# EasyEDA Pro project FPGA-G1.eprj, board logi Pi (continued)
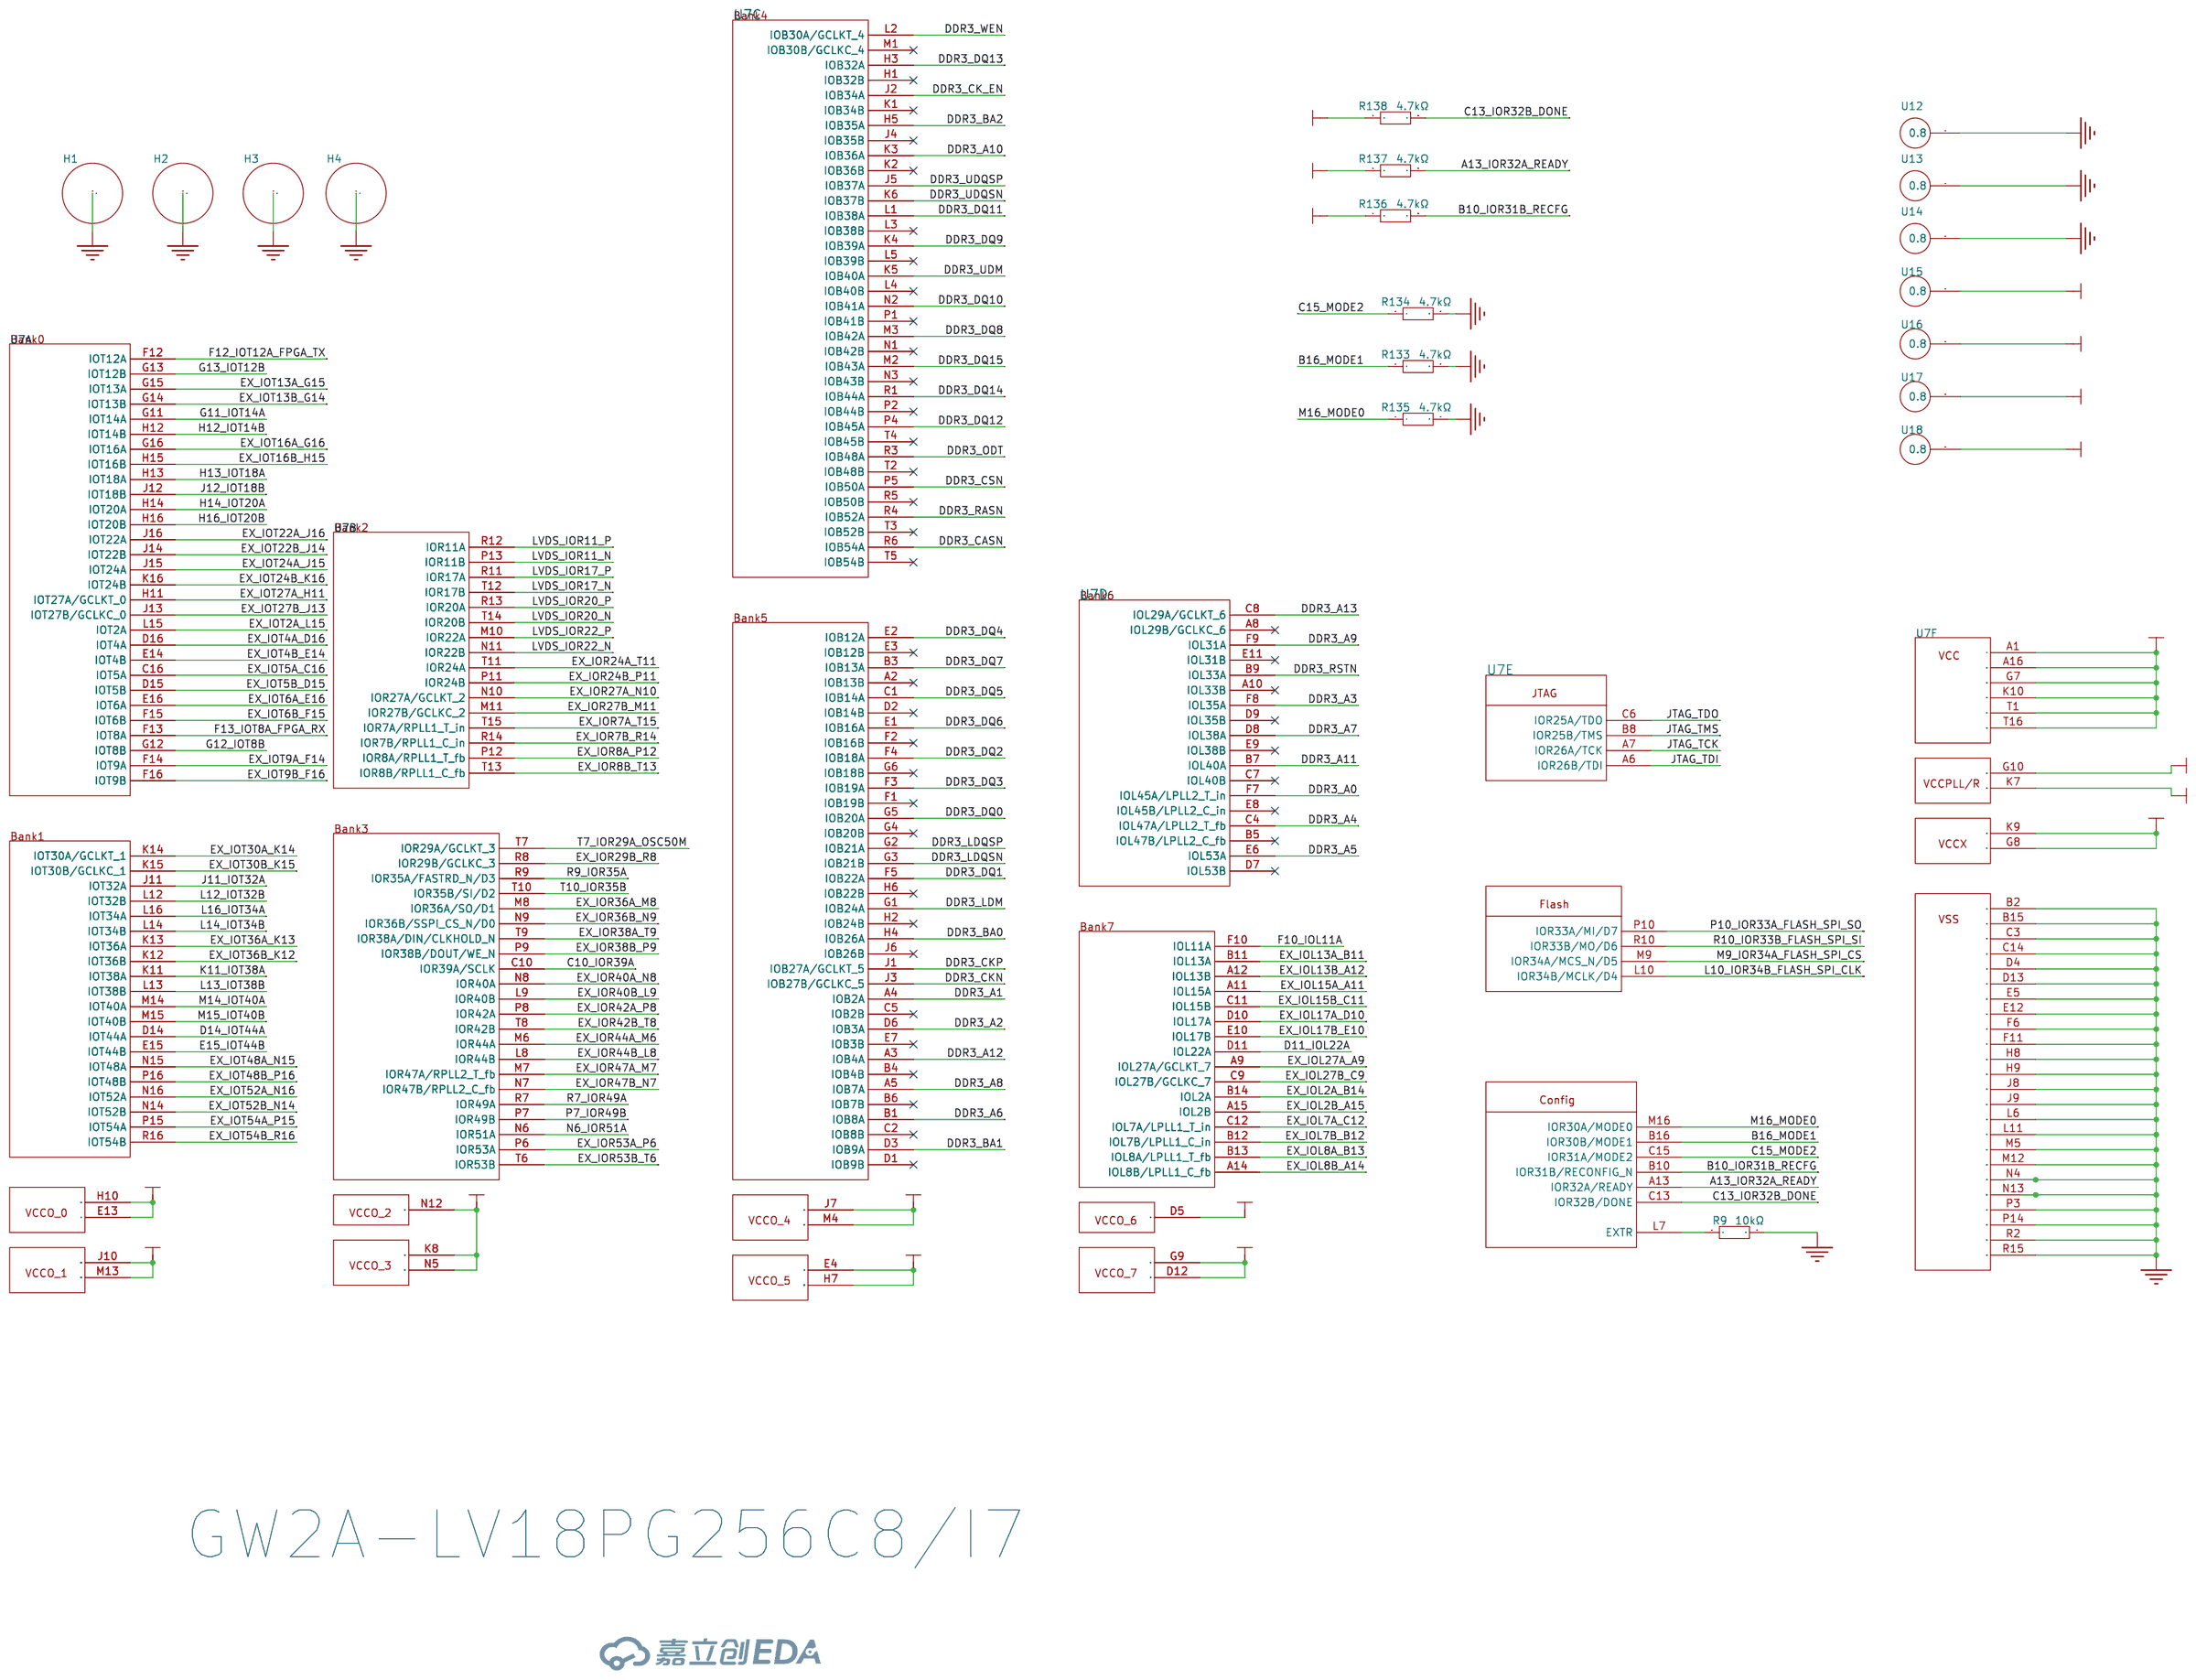
[diagram p0: FPGA]
## Routing (per net, layer and track width the routed paths; a pad name or vN(x,y) marks a point on that pad's centre or on a via; arc(x,y) is an arc through that point) (continued)
C6_IOR25A_JTAG_TDO: length 3.4
  Top Layer w0.109: RN1.2 15.28,62.31 14.96,62.62 14.96,62.97 14.51,63.42 U20.6
C10_IOR39A: length 32.2
  Top Layer w0.109: 17.38,25.22 v1(17.38,25.64) ; U7.C10 v1(29.7,42.09)
  SIG04 w0.109: v1(17.38,25.64) 18.03,25.64 19.42,24.26 20.98,24.26 21.71,23.53 23.44,23.53 23.75,23.84 26.9,23.84 29.11,26.05 29.11,29.37 28.95,29.53 28.47,29.53 28.14,29.86 28.14,38.99 29.33,40.18 29.33,41.71 v1(29.7,42.09)
C13_IOR32B_DONE: length 5.5
  Top Layer w0.109: v1(33.6,45.36) 33.92,45.36 34.24,45.68 R138.2 ; U7.C13 v1(32.7,42.09)
  SIG03 w0.109: v1(32.7,42.09) 33.6,42.99 v1(33.6,45.36)
C15_MODE2: length 6
  Top Layer w0.109: R134.1 35.16,45.64 36.09,44.72 36.09,43.69 35.49,43.09 34.95,43.09 34.71,42.85 34.71,42.09 34.22,41.59 U7.C15
D11_IOL22A: length 34.1
  Top Layer w0.109: 27.28,18.63 28.06,18.63 28.62,18.07 ; 26.72,16.41 26.49,16.19 26.49,13.6 26.77,13.32 R61.1 28.64,13.32 SW2.1 ; 26.72,16.41 26.74,16.43 27.14,16.43 ; 26.72,16.41 26.71,16.41 26.5,16.62 26.5,18.44 26.77,18.71 27,18.71 ; 27.18,18.65 27.18,19.2 26.97,19.4 v1(26.52,19.4) ; U7.D11 v1(29.7,40.09)
  SIG04 w0.109: v1(26.52,19.4) 27.75,20.64 27.75,23.62 29.32,25.18 29.32,30.49 29.1,30.71 29.1,39.23 29.7,39.83 v1(29.7,40.09)
D14_IOT44A: length 15.2
  Top Layer w0.109: v1(34.33,52.25) 33.81,52.25 33.52,52.54 33.52,53.36 33.62,53.46 U1.13 ; U7.D14 v1(33.7,41.09)
  SIG04 w0.109: v1(34.33,52.25) 33.7,51.62 33.7,48.6 33.19,48.09 33.19,43.6 33.32,43.47 33.32,41.48 v1(33.7,41.09)
DDR3_A0: length 27.2
  Top Layer w0.109: U7.F7 v1(25.7,39.09) ; U29.N3 v1(15.1,38.64)
  SIG04 w0.109: v1(25.7,39.09) 25.7,39.08 25.28,38.65 25.28,36.76 25.42,36.61 26.65,36.61 26.81,36.46 26.81,35.68 26.61,35.49 25.88,35.49 25.87,35.49 25.48,35.49 25.4,35.57 25.4,35.94 25.32,36.02 25.15,36.02 25.07,35.94 25.07,35.57 25,35.49 24.54,35.49 24.43,35.6 24.43,38.2 24,38.64 22.61,38.64 22.45,38.8 18.65,38.8 18.08,38.23 15.51,38.23 v1(15.1,38.64)
  Bottom Layer w0.109: v1(15.1,38.64) 15.1,40.27 14.73,40.64 14.14,40.64 13.88,40.9 R123.2
DDR3_A1: length 26.7
  Top Layer w0.109: v1(11.1,39.44) U29.P7 12.5,40.04 12.5,42.02 12,42.51 R122.2 ; v1(22.7,44) 23.11,43.59 U7.A4
  SIG03 w0.109: v1(11.1,39.44) 11.1,40.12 16.51,45.52 18.03,45.52 18.11,45.45 18.11,44.97 18.19,44.89 18.36,44.89 18.44,44.97 18.44,45.45 18.52,45.52 18.69,45.52 18.77,45.45 18.77,44.97 18.84,44.89 19.02,44.89 19.09,44.97 19.09,45.45 19.17,45.52 19.34,45.52 19.42,45.45 19.42,44.97 19.5,44.89 19.67,44.89 19.75,44.97 19.75,45.45 19.83,45.52 20,45.52 20.08,45.45 20.08,44.97 20.15,44.89 20.33,44.89 20.4,44.97 20.4,45.45 20.48,45.52 20.65,45.52 20.73,45.45 20.73,44.97 20.81,44.89 20.98,44.89 21.06,44.97 21.06,45.45 21.14,45.52 22,45.52 22.23,45.3 22.23,44.47 v1(22.7,44)
DDR3_A2: length 25.2
  Top Layer w0.109: R121.2 13.52,42.55 v1(13.52,40.26) 13.52,39.9 14.36,39.06 14.72,39.06 ; U7.D6 v1(24.7,41.09)
  SIG04 w0.109: 13.53,40.24 13.53,41.01 13.98,41.46 15.01,41.46 15.09,41.38 15.09,40.71 15.17,40.63 15.34,40.63 15.42,40.71 15.42,41.38 15.49,41.46 15.67,41.46 15.74,41.38 15.74,40.71 15.82,40.63 15.99,40.63 16.07,40.71 16.07,41.38 16.15,41.46 17.62,41.46 18.11,41.96 18.11,42.07 18.03,42.15 18.03,42.26 18.15,42.38 18.26,42.38 18.34,42.3 18.45,42.3 19.63,43.48 21.16,43.48 21.24,43.4 21.24,42.91 21.32,42.84 21.49,42.84 21.57,42.91 21.57,43.4 21.65,43.48 21.82,43.48 21.9,43.4 21.9,42.91 21.97,42.84 22.15,42.84 22.22,42.91 22.22,43.4 22.3,43.48 22.9,43.48 24.7,41.68 v1(24.7,41.09)
DDR3_A3: length 27.1
  Top Layer w0.109: U7.F8 v1(26.7,39.09) ; 15.6,42.8 15.6,42.2 v1(15.87,41.92) ; U29.N2 v1(15.9,38.64)
  SIG04 w0.109: v1(15.9,38.64) 15.9,38.67 16.36,39.13 17.5,39.13 17.58,39.05 17.58,38.91 17.65,38.83 17.83,38.83 17.9,38.91 17.9,39.05 17.98,39.13 19.36,39.13 19.43,39.21 19.43,39.63 19.51,39.71 19.68,39.71 19.76,39.63 19.76,39.21 19.84,39.13 20.01,39.13 20.09,39.21 20.09,39.61 20.17,39.69 20.34,39.69 20.42,39.61 20.42,39.2 20.49,39.13 20.67,39.13 20.74,39.21 20.74,39.57 20.82,39.64 21,39.64 21.07,39.57 21.07,39.21 21.15,39.13 21.32,39.13 21.4,39.21 21.4,39.58 21.48,39.66 21.65,39.66 21.73,39.58 21.73,39.21 21.81,39.13 22.02,39.13 22.51,39.62 24.61,39.62 24.68,39.69 24.68,39.86 24.76,39.93 24.93,39.93 25.01,39.86 25.01,39.69 25.09,39.62 25.26,39.62 25.34,39.69 25.34,39.86 25.42,39.93 25.59,39.93 25.67,39.86 25.67,39.69 25.74,39.62 27.09,39.62 27.41,39.3 27.41,38.7 27.22,38.5 27.22,37.83 27.03,37.64 26.39,37.64 26.24,37.79 26.24,38.63 v1(26.7,39.09)
  Bottom Layer w0.109: v1(15.87,41.92) 15.43,41.49 15.43,39.11 v1(15.9,38.64)
DDR3_A4: length 24.6
  Top Layer w0.109: U7.C4 22.7,42.09 v1(22.7,43.09) ; U29.P8 v1(10.3,39.44)
  SIG03 w0.109: v1(22.7,43.09) 21.25,43.09 20.86,43.48 20.35,43.48 20.14,43.26 20.14,43.06 20.06,42.99 19.88,42.99 19.81,43.06 19.81,43.26 19.73,43.34 19.56,43.34 19.48,43.26 19.48,43.06 19.4,42.99 19.23,42.99 19.15,43.06 19.15,43.26 19.08,43.34 18.9,43.34 18.83,43.26 18.83,43.06 18.75,42.99 18.57,42.99 18.5,43.06 18.5,43.26 18.42,43.34 18.25,43.34 18.17,43.26 18.17,43.06 18.09,42.99 17.92,42.99 17.84,43.06 17.84,43.26 17.76,43.34 17.59,43.34 17.51,43.26 17.51,43.06 17.44,42.99 17.26,42.99 17.19,43.06 17.19,43.26 17.11,43.34 16.94,43.34 16.86,43.26 16.86,43.06 16.78,42.99 16.61,42.99 16.53,43.06 16.53,43.26 16.45,43.34 16.28,43.34 16.2,43.26 16.2,43.06 16.13,42.99 15.95,42.99 15.88,43.06 15.88,43.26 15.8,43.34 15.35,43.34 13.92,41.9 13.92,41.2 12.87,40.16 12.87,39.8 11.29,38.21 10.89,38.21 10.69,38.41 10.69,39.05 v1(10.3,39.44)
  Bottom Layer w0.109: v1(10.3,39.44) 9.92,39.83 9.2,39.83 8.67,40.36 R119.1
DDR3_A5: length 25.1
  Top Layer w0.109: U29.P2 15.64,39.04 15.89,39.3 15.89,40.24 ; U7.E6 25.7,40.09 v1(25.7,42.09)
  SIG04 w0.109: v1(25.7,42.09) 25.82,41.97 25.82,40.8 25.66,40.64 25.52,40.64 25.44,40.72 25.44,41.36 25.37,41.44 25.19,41.44 25.12,41.36 25.12,40.72 25.04,40.64 24.55,40.64 24.14,41.05 24.14,41.62 23.28,42.48 23.17,42.48 23.09,42.4 23.09,42.06 23.02,41.99 22.84,41.99 22.77,42.06 22.77,42.4 22.69,42.48 22.52,42.48 22.44,42.4 22.44,42.06 22.36,41.99 22.19,41.99 22.11,42.06 22.11,42.4 22.03,42.48 21.23,42.48 21.15,42.4 21.15,42.06 21.08,41.99 20.9,41.99 20.83,42.06 20.83,42.4 20.75,42.48 20.58,42.48 20.5,42.4 20.5,42.06 20.42,41.99 20.25,41.99 20.17,42.06 20.17,42.4 20.09,42.48 19.48,42.48 17.24,40.24 v1(15.89,40.24)
  Bottom Layer w0.109: v1(15.89,40.24) 16.29,40.64 16.29,42.45 16.7,42.85 R118.1
DDR3_A6: length 25.7
  Top Layer w0.109: U7.B1 19.02,43.77 19.02,45.7 v1(18.62,46.1) ; U29.R8 v1(10.3,40.24)
  SIG03 w0.109: v1(18.62,46.1) 18.61,46.11 15.94,46.11 15.6,45.77 15.6,45.66 15.81,45.45 15.81,45.34 15.69,45.22 15.58,45.22 15.37,45.43 15.26,45.43 15.14,45.31 15.14,45.2 15.35,44.98 15.35,44.88 15.23,44.75 15.12,44.75 14.91,44.97 14.8,44.97 14.67,44.84 14.67,44.74 14.89,44.52 14.89,44.41 14.77,44.29 14.66,44.29 14.44,44.5 14.33,44.5 14.21,44.38 14.21,44.27 14.42,44.06 14.42,43.95 14.3,43.83 14.19,43.83 13.98,44.04 13.87,44.04 13.75,43.92 13.75,43.81 13.96,43.59 13.96,43.49 13.84,43.36 13.73,43.36 13.51,43.58 13.41,43.58 13.28,43.45 13.28,43.35 13.5,43.13 13.5,43.02 13.38,42.9 13.27,42.9 13.05,43.11 12.94,43.11 12.82,42.99 12.82,42.88 13.03,42.67 13.03,42.56 12.91,42.44 12.8,42.44 12.59,42.65 12.48,42.65 12.36,42.53 12.36,42.42 12.57,42.2 12.57,42.09 12.45,41.97 12.34,41.97 12.12,42.19 12.02,42.19 11.89,42.06 11.89,41.96 12.11,41.74 12.11,41.63 11.98,41.51 11.88,41.51 11.66,41.72 11.55,41.72 10.3,40.47 v1(10.3,40.24)
  Bottom Layer w0.109: v1(10.3,40.24) 9.88,40.67 9.88,41.23 8.26,42.85 R117.1
DDR3_A7: length 23.6
  Top Layer w0.109: U7.D8 27.2,40.65 v1(26.74,41.11) ; v1(15.1,41.89) 15.1,40.25 U29.R2
  SIG04 w0.109: v1(26.74,41.11) 27.27,41.64 27.27,42.07 25.69,43.65 25.58,43.65 25.4,43.48 25.29,43.48 25.17,43.6 25.17,43.71 25.34,43.88 25.34,43.99 25.22,44.12 25.11,44.12 24.94,43.94 24.83,43.94 24.71,44.06 24.71,44.17 24.88,44.35 24.88,44.46 24.58,44.75 18.6,44.75 18.49,44.64 18.49,44.22 18.41,44.15 18.24,44.15 18.16,44.22 18.16,44.64 18.08,44.71 17.91,44.71 17.83,44.64 17.83,44.22 17.75,44.15 17.58,44.15 17.5,44.22 17.5,44.64 17.39,44.75 17.01,44.75 15.1,42.84 v1(15.1,41.89)
  Bottom Layer w0.109: v1(15.1,41.89) 15.1,42.2 R116.1
DDR3_A8: length 24.5
  Top Layer w0.109: U29.T8 v1(10.3,41.04) 10.1,41.25 R115.1 ; U7.A5 24.29,43.59 ; 24.2,43.59 24.17,43.59 22.67,45.09
  SIG04 w0.109: v1(22.7,45.14) 22.45,45.14 21.89,45.69 15.68,45.69 15.33,45.34 15.33,45.23 15.7,44.86 15.7,44.75 15.58,44.63 15.47,44.63 15.09,45 14.98,45 14.86,44.88 14.86,44.77 15.24,44.4 15.24,44.29 15.11,44.17 15,44.17 14.63,44.54 14.52,44.54 14.4,44.42 14.4,44.31 14.77,43.93 14.77,43.83 14.65,43.7 14.54,43.7 14.17,44.08 14.06,44.08 13.94,43.95 13.94,43.84 14.31,43.47 14.31,43.36 14.19,43.24 14.08,43.24 13.7,43.61 13.59,43.61 13.34,43.36 13.23,43.36 13.11,43.49 13,43.49 12.87,43.37 12.87,43.26 13,43.13 13,43.02 11.02,41.04 v1(10.3,41.04)
DDR3_A9: length 25.4
  Top Layer w0.109: v1(26.74,40.11) 27.44,40.11 27.73,39.81 27.73,39.03 28.17,38.59 U7.F9 ; U29.R3 v1(14.3,40.24) 14.3,40.31 13.87,40.74 13.87,41.99 14.77,42.89 R114.1
  SIG04 w0.109: 26.71,40.05 26.71,40.13 26.53,40.32 24.41,40.32 24.16,40.57 23.51,40.57 23.17,40.91 23.17,41.37 22.91,41.63 22.42,41.63 22.34,41.55 22.34,41.33 22.26,41.25 22.09,41.25 22.01,41.33 22.01,41.55 21.94,41.63 21.15,41.63 21.07,41.55 21.07,40.91 21,40.84 20.82,40.84 20.74,40.91 20.74,41.55 20.67,41.63 20.49,41.63 20.42,41.55 20.42,40.91 20.34,40.84 20.17,40.84 20.09,40.91 20.09,41.55 20.01,41.63 19.84,41.63 19.76,41.55 19.76,40.91 19.68,40.84 19.51,40.84 19.43,40.91 19.43,41.55 19.36,41.63 19.09,41.63 17.25,39.79 14.75,39.79 v1(14.3,40.24)
DDR3_A10: length 29
  Top Layer w0.109: v1(11.1,37.04) U29.L7 12.83,37.97 12.83,42.83 R113.1 ; U7.K3 v1(21.7,34.09)
  SIG04 w0.109: v1(11.1,37.04) 11.1,37.51 11.31,37.72 12.91,37.72 15.57,35.06 16.74,35.06 18.17,36.49 18.57,36.49 18.65,36.41 18.65,36.08 18.73,36 18.9,36 18.98,36.08 18.98,36.41 19.05,36.49 19.23,36.49 19.3,36.41 19.3,35.95 19.38,35.88 19.55,35.88 19.63,35.95 19.63,36.41 19.71,36.49 19.88,36.49 19.96,36.41 19.96,36.03 20.04,35.95 20.21,35.95 20.29,36.03 20.29,36.41 20.36,36.49 20.88,36.49 21.55,35.82 21.55,35.59 21.47,35.51 20.78,35.51 20.7,35.43 20.7,35.26 20.78,35.18 21.62,35.18 21.7,35.1 21.7,34.93 21.62,34.85 20.78,34.85 20.7,34.78 20.7,34.6 20.78,34.53 21.62,34.53 21.7,34.45 v1(21.7,34.09)
DDR3_A11: length 25.6
  Top Layer w0.109: v1(12.04,40.29) 11.59,39.84 U29.R7 11.11,40.24 11.11,42.83 R112.1 ; U7.B7 v1(25.7,43.09)
  SIG03 w0.109: v1(12.04,40.29) 12.04,40.59 15.86,44.41 16.65,44.41 16.72,44.49 16.72,44.78 16.8,44.85 16.97,44.85 17.05,44.78 17.05,44.49 17.13,44.41 17.3,44.41 17.38,44.49 17.38,44.78 17.46,44.85 17.63,44.85 17.71,44.78 17.71,44.49 17.78,44.41 21.51,44.41 22.31,43.62 23.09,43.62 23.16,43.54 23.16,43.04 23.24,42.96 23.41,42.96 23.49,43.04 23.49,43.54 23.57,43.62 23.74,43.62 23.82,43.54 23.82,43.04 23.9,42.96 24.07,42.96 24.15,43.04 24.15,43.54 24.22,43.62 24.4,43.62 24.47,43.54 24.47,43.04 24.55,42.96 24.72,42.96 24.8,43.04 24.8,43.54 24.88,43.62 25.18,43.62 v1(25.7,43.09)
DDR3_A12: length 27.4
  Top Layer w0.109: 21.66,45.09 21.73,45.09 22.2,44.62 U7.A3 ; U29.N7 v1(11.1,38.64)
  SIG04 w0.109: 21.66,45.09 21.39,45.37 16.87,45.37 14.15,42.65 14.04,42.65 13.64,43.05 13.53,43.05 13.41,42.93 13.41,42.82 13.81,42.42 13.81,42.31 13.69,42.19 13.58,42.19 13.18,42.59 13.07,42.59 12.95,42.47 12.95,42.36 13.35,41.96 13.35,41.85 13.22,41.73 13.12,41.73 12.72,42.13 12.61,42.13 12.48,42 12.48,41.89 12.88,41.49 12.88,41.39 12.76,41.26 12.65,41.26 12.25,41.66 12.14,41.66 12.02,41.54 12.02,41.43 12.42,41.03 12.42,40.92 12.19,40.69 11.16,40.69 10.72,40.24 10.72,39.03 v1(11.1,38.64)
  Bottom Layer w0.109: R111.1 9.18,42.89 10.69,41.39 10.69,38.99 11.04,38.64 v1(11.1,38.64)
  vias: v1(21.7,45.14)
DDR3_A13: length 24.3
  Top Layer w0.109: U7.C8 v1(26.7,42.09) ; U29.T3 v1(14.3,41.04)
  SIG03 w0.109: v1(26.7,42.09) 26.19,42.6 25.3,42.6 25.22,42.52 25.22,41.86 25.14,41.78 24.97,41.78 24.89,41.86 24.89,42.52 24.81,42.6 24.64,42.6 24.56,42.52 24.56,41.86 24.49,41.78 24.31,41.78 24.24,41.86 24.24,42.52 24.16,42.6 23.99,42.6 23.91,42.52 23.91,41.86 23.83,41.78 23.66,41.78 23.58,41.86 23.58,42.52 23.5,42.6 23.33,42.6 23.25,42.52 23.25,41.86 23.18,41.78 23,41.78 22.93,41.86 22.93,42.52 22.85,42.6 22.68,42.6 22.6,42.52 22.6,41.86 22.52,41.78 22.35,41.78 22.27,41.86 22.27,42.52 22.19,42.6 15.08,42.6 14.3,41.83 v1(14.3,41.04)
  Bottom Layer w0.109: R110.1 14.3,42.35 v1(14.3,41.04)
DDR3_BA0: length 28
  Top Layer w0.109: U7.H4 v1(22.7,37.09) ; U29.M2 15.9,37.84
  Bottom Layer w0.109: v1(22.7,37.09) 22.7,38.34 22.5,38.54 22.12,38.54 22.04,38.62 22.04,39.53 21.96,39.61 21.79,39.61 21.71,39.53 21.71,38.62 21.64,38.54 21.46,38.54 21.39,38.62 21.39,39.53 21.31,39.61 21.14,39.61 21.06,39.53 21.06,38.62 20.98,38.54 20.81,38.54 20.73,38.62 20.73,39.53 20.65,39.61 20.48,39.61 20.4,39.53 20.4,38.62 20.33,38.54 20.15,38.54 20.08,38.62 20.08,39.53 20,39.61 19.83,39.61 19.75,39.53 19.75,38.62 19.67,38.54 18.96,38.54 18.26,37.84 17.69,37.84 17.61,37.92 17.61,38.63 17.69,38.71 18.3,38.71 18.38,38.79 18.38,38.96 18.3,39.04 17.69,39.04 17.61,39.12 17.61,39.55 17.53,39.63 17.36,39.63 17.28,39.55 17.28,37.92 17.21,37.84 15.9,37.84 ; v1(15.9,37.84) 16,37.84 16.45,38.29 16.45,39.27 17.11,39.94 17.11,41.55 17.63,42.07 R126.2
DDR3_BA1: length 24.1
  Top Layer w0.109: U7.D3 v1(21.7,41.09) ; U29.N8 v1(10.3,38.64)
  SIG04 w0.109: v1(10.3,38.64) 10.8,38.14 11.67,38.14 11.75,38.22 11.75,39.04 11.83,39.12 12,39.12 12.08,39.04 12.08,38.22 12.16,38.14 12.33,38.14 12.41,38.22 12.41,39.04 12.48,39.11 12.66,39.11 12.73,39.04 12.73,38.22 12.81,38.14 12.99,38.14 13.06,38.22 13.06,39.03 13.14,39.11 13.32,39.11 13.39,39.03 13.39,38.21 13.47,38.14 13.64,38.14 13.72,38.22 13.72,39.03 13.79,39.11 13.97,39.11 14.05,39.03 14.05,38.22 14.12,38.14 14.28,38.14 14.38,38.25 14.38,39.17 14.68,39.46 18.3,39.46 18.47,39.63 18.47,39.94 19,40.48 21.57,40.48 21.7,40.61 v1(21.7,41.09)
  Bottom Layer w0.109: R125.2 8.97,39.35 9.28,39.04 9.96,39.04 10.3,38.7 v1(10.3,38.64)
DDR3_BA2: length 28.2
  Top Layer w0.109: v1(15.1,37.85) 14.7,37.45 U29.M3 ; U7.H5 v1(23.7,37.09)
  Bottom Layer w0.109: v1(23.7,37.09) 22.85,36.24 22.85,35.83 22.7,35.68 22.34,35.68 22.2,35.82 22.2,36.19 22.13,36.26 21.56,36.26 21.48,36.34 21.48,36.51 21.56,36.59 22.13,36.59 22.2,36.67 22.2,37.33 22.08,37.46 20.05,37.46 19.97,37.38 19.97,36.38 19.89,36.3 19.72,36.3 19.64,36.38 19.64,37.38 19.57,37.46 19.39,37.46 19.32,37.38 19.32,36.38 19.24,36.3 19.07,36.3 18.99,36.38 18.99,37.38 18.91,37.46 18.74,37.46 18.66,37.38 18.66,36.38 18.58,36.3 18.41,36.3 18.33,36.38 18.33,37.38 18.26,37.46 18.08,37.46 18.01,37.38 18.01,36.38 17.93,36.3 17.75,36.3 17.68,36.38 17.68,37.38 17.6,37.46 15.49,37.46 v1(15.1,37.85) 13.91,39.03 13.91,40.41 13.42,40.9 13.42,42.38 12.94,42.85 R124.2
DDR3_CASN: length 29.7
  Top Layer w0.109: U29.K3 14.23,36.31 v1(14.23,37.04) ; U7.R6 24.7,29.09 v1(23.7,29.09)
  SIG04 w0.109: v1(23.7,29.09) 23.72,29.09 24.09,29.46 24.09,37.48 23.87,37.7 23.25,37.7 23.14,37.8 22.98,37.8 22.31,38.48 18.89,38.48 18.22,37.8 17.55,37.8 17.19,37.44 14.63,37.44 v1(14.23,37.04)
  Bottom Layer w0.109: v1(14.23,37.04) 12.76,38.52 12.76,41.18 R127.1
DDR3_CK_EN: length 23.7
  Top Layer w0.109: U29.K9 v1(9.5,36.24) ; U7.J2 21.09,35.59 v1(20.7,35.98)
  SIG04 w0.109: v1(20.7,35.98) 20.06,35.33 20.06,33.67 19.69,33.31 19.69,31.08 19.33,30.72 17.33,30.72 17.1,30.95 17.1,31.61 16.85,31.86 14.94,31.86 14.69,32.1 14.69,33.55 13.49,34.76 11.92,34.76 11.84,34.68 11.84,34.54 11.77,34.47 11.59,34.47 11.52,34.54 11.52,34.68 11.44,34.76 11.27,34.76 11.19,34.68 11.19,34.54 11.11,34.47 10.94,34.47 10.86,34.54 10.86,34.68 10.78,34.76 10.61,34.76 10.53,34.68 10.53,34.54 10.46,34.47 10.28,34.47 10.21,34.54 10.21,34.68 10.13,34.76 9.66,34.76 9.5,34.92 v1(9.5,36.24)
  Bottom Layer w0.109: 9.47,36.22 8.31,36.22 8.2,36.11
DDR3_CKN: length 23.4
  Top Layer w0.104: U7.J3 21.73,35.12 19.84,35.12 19.67,34.95 v1(19.67,34.32) ; U29.K7 v1(11.1,36.24)
  SIG04 w0.104: v1(11.1,36.24) 11.34,36 11.99,36 12.06,36.07 12.06,36.25 12.31,36.5 12.74,36.5 13,36.25 13,36.07 13.07,36 14,36 15.31,34.69 16.83,34.69 17.2,35.06 17.51,35.06 17.77,34.81 17.77,31.46 17.84,31.39 18.02,31.39 18.09,31.46 18.09,32.84 18.35,33.09 18.5,33.09 18.58,33.17 18.58,33.35 18.5,33.42 18.35,33.42 18.09,33.67 18.09,34.81 18.35,35.06 19.34,35.06 19.45,34.96 19.45,34.42 19.54,34.32 v1(19.67,34.32)
  Bottom Layer w0.104: R106.2 19.37,35.04 19.37,34.62 v1(19.67,34.32)
DDR3_CKP: length 23.4
  Top Layer w0.104: v1(18.76,34.32) 18.76,35.41 18.94,35.59 19.12,35.59 19.23,35.7 19.23,36.22 19.3,36.29 19.48,36.29 19.56,36.22 19.56,35.74 19.71,35.59 U7.J1 ; U29.J7 v1(11.1,35.44)
  SIG04 w0.104: v1(18.76,34.32) 18.77,34.32 19.02,34.32 19.14,34.44 19.14,34.63 19.02,34.75 18.47,34.75 18.4,34.68 18.4,33.8 18.47,33.73 18.63,33.73 18.88,33.47 18.88,33.04 18.63,32.79 18.47,32.79 18.4,32.71 18.4,31.33 18.15,31.08 17.71,31.08 17.46,31.33 17.46,34.67 17.39,34.74 17.31,34.74 16.9,34.32 15.1,34.32 13.73,35.69 12.88,35.69 12.69,35.88 12.69,36.12 12.62,36.2 12.44,36.2 12.36,36.12 12.36,35.82 12.24,35.69 11.33,35.69 11.1,35.47 v1(11.1,35.44)
  Bottom Layer w0.104: v1(18.76,34.32) 19.07,34.62 19.07,35.06 R106.1
DDR3_CSN: length 22.5
  Top Layer w0.109: U7.P5 v1(23.7,30.09) ; U29.L2 v1(15.9,37.04)
  SIG04 w0.109: v1(23.7,30.09) 23.7,29.8 23.59,29.69 23.3,29.69 23.19,29.8 23.19,31.24 23.27,31.32 23.39,31.32 23.47,31.4 23.47,31.57 23.39,31.65 23.27,31.65 23.19,31.73 23.19,32.83 23.41,33.05 23.41,33.29 23.49,33.37 23.65,33.37 23.73,33.44 23.73,33.62 23.65,33.69 23.49,33.69 23.41,33.77 23.41,33.94 23.49,34.02 23.65,34.02 23.73,34.1 23.73,34.27 23.65,34.35 23.49,34.35 23.41,34.43 23.41,34.77 23.19,35 23.19,35.01 23.11,35.08 22.91,35.08 22.83,35.16 22.83,35.33 22.91,35.41 23.11,35.41 23.19,35.49 23.19,35.66 23.11,35.74 22.92,35.74 22.85,35.82 22.85,35.99 22.92,36.07 23.11,36.07 23.19,36.14 23.19,36.32 23.11,36.39 22.88,36.39 22.8,36.47 22.8,36.64 22.88,36.72 23.11,36.72 23.19,36.8 23.19,37.15 22.86,37.48 22.2,37.48 22.12,37.55 22.12,37.65 22.04,37.73 21.87,37.73 21.79,37.65 21.79,37.55 21.72,37.48 21.54,37.48 21.46,37.55 21.46,37.75 21.39,37.82 21.21,37.82 21.14,37.75 21.14,37.55 21.06,37.48 20.89,37.48 20.81,37.55 20.81,37.58 20.73,37.66 20.56,37.66 20.48,37.58 20.48,37.55 20.4,37.48 20.23,37.48 20.15,37.55 20.15,37.65 20.08,37.73 19.9,37.73 19.83,37.65 19.83,37.55 19.75,37.48 19.58,37.48 19.5,37.55 19.5,37.65 19.42,37.73 19.25,37.73 19.17,37.65 19.17,37.55 19.09,37.48 18.92,37.48 18.84,37.55 18.84,37.64 18.77,37.71 18.59,37.71 18.52,37.64 18.52,37.55 18.44,37.48 17.68,37.48 16.86,36.65 16.29,36.65 v1(15.9,37.04) 15.91,37.05
DDR3_DQ0: length 21.2
  Top Layer w0.109: U7.G5 23.71,38.08 v1(23.7,38.08) ; U29.E3 v1(15.1,31.44)
  SIG03 w0.109: 17.77,31.31 17.77,30.66 17.85,30.59 18.02,30.59 18.1,30.66 ; v1(15.1,31.44) 15.49,31.05 17.04,31.05 17.12,30.97 17.12,30.66 17.19,30.59 17.37,30.59 17.44,30.66 ; 18.43,31.31 18.43,30.66 18.5,30.59 18.89,30.59 19.19,30.89 19.19,31.41 19.31,31.53 19.8,31.53 19.89,31.44 20,31.44 20.12,31.56 20.12,31.67 20.03,31.77 20.03,31.87 20.15,32 20.26,32 20.35,31.9 20.46,31.9 20.59,32.03 20.59,32.14 20.38,32.34 20.38,32.45 20.5,32.57 20.61,32.57 20.82,32.37 20.93,32.37 21.05,32.49 21.05,32.6 20.87,32.77 20.87,32.88 21,33.01 21.1,33.01 21.28,32.83 21.39,32.83 21.51,32.95 21.51,33.06 21.42,33.16 21.42,33.27 21.54,33.39 21.65,33.39 21.74,33.29 21.85,33.29 21.98,33.42 21.98,33.53 21.88,33.62 21.88,33.73 22.17,34.02 22.17,34.34 23.52,35.68 23.93,35.68 24.1,35.85 24.1,37.68 v1(23.7,38.08) ; 17.44,30.66 17.44,31.31 17.52,31.38 17.69,31.38 17.77,31.31 ; 18.1,30.66 18.1,31.31 18.18,31.38 18.35,31.38 18.43,31.31
DDR3_DQ1: length 21.1
  Top Layer w0.109: U29.F7 11.56,32.64 v1(11.96,32.24) ; U7.F5 24.14,38.59 v1(23.59,39.14)
  SIG03 w0.109: v1(23.59,39.14) 23.61,39.14 24.43,38.32 24.43,35.36 23.46,34.39 23.46,34.16 22.53,33.23 22.3,33.23 19.33,30.26 14.46,30.26 13.69,31.03 13.18,31.03 v1(11.96,32.24)
DDR3_DQ2: length 21.2
  Top Layer w0.109: U7.F4 v1(22.7,39.09) ; U29.F2 v1(15.9,32.24)
  SIG03 w0.109: v1(15.9,32.24) 16.29,31.85 16.9,31.85 17.1,31.65 17.3,31.65 17.4,31.75 17.4,32.2 17.48,32.28 17.65,32.28 17.73,32.2 17.73,31.78 17.81,31.7 17.98,31.7 18.06,31.78 18.06,32.2 18.13,32.28 18.31,32.28 18.38,32.2 18.38,31.84 18.54,31.68 18.77,31.68 18.9,31.82 18.9,32.53 19.02,32.66 19.37,32.66 19.6,32.42 19.87,32.42 20.1,32.64 20.1,32.75 19.71,33.14 19.71,33.25 19.83,33.37 19.94,33.37 20.33,32.99 20.44,32.99 20.56,33.11 20.56,33.22 20.18,33.6 20.18,33.71 20.3,33.83 20.41,33.83 20.79,33.45 20.9,33.45 21.32,33.87 21.32,34.42 21.65,34.76 21.76,34.76 21.89,34.63 22,34.63 22.12,34.75 22.12,34.86 21.99,34.99 21.99,35.1 22.12,35.22 22.22,35.22 22.35,35.09 22.46,35.09 22.58,35.21 22.58,35.32 22.46,35.45 22.46,35.56 22.58,35.68 22.69,35.68 22.82,35.55 22.93,35.55 23.05,35.68 23.05,35.79 22.92,35.91 22.92,36.1 23.24,36.42 23.49,36.42 23.57,36.5 23.57,36.67 23.49,36.75 23.28,36.75 23.2,36.83 23.2,37.07 23.29,37.16 23.29,37.4 23.2,37.48 23.2,37.73 23.28,37.81 23.28,38.06 23.2,38.14 23.2,38.59 v1(22.7,39.09)
DDR3_DQ3: length 21.3
  Top Layer w0.109: U7.F3 21.68,39.12 20.08,39.12 v1(19.05,38.09) ; U29.F8 v1(10.3,32.24)
  SIG03 w0.109: v1(19.05,38.09) 19.02,38.06 18.59,38.06 18.51,38.14 18.51,38.97 18.43,39.05 18.26,39.05 18.18,38.97 18.18,38.14 18.11,38.06 17.93,38.06 17.86,38.14 17.86,38.97 17.78,39.05 17.61,39.05 17.53,38.97 17.53,38.14 17.45,38.06 17.25,38.06 17.08,38.24 13.64,38.24 13.03,37.63 13.03,35.67 11.54,34.18 11.54,32.62 11.27,32.35 10.41,32.35 v1(10.3,32.24)
DDR3_DQ4: length 21.2
  Top Layer w0.109: U7.E2 v1(20.7,40.09) ; U29.H3 v1(15.1,33.84)
  SIG03 w0.109: v1(20.7,40.09) 20.7,40.59 20.82,40.71 21.28,40.71 21.36,40.63 21.36,40.06 21.44,39.98 21.61,39.98 21.69,40.06 21.69,40.63 21.77,40.71 22.07,40.71 22.19,40.59 22.19,39.88 22.27,39.81 22.44,39.81 22.52,39.73 22.52,39.56 22.44,39.48 22.27,39.48 22.19,39.4 22.19,38.98 22.7,38.47 22.7,37.63 22.32,37.25 22.32,36.32 19.48,33.48 19.11,33.48 18.89,33.25 18.89,32.98 18.54,32.63 18.35,32.63 18.27,32.71 18.27,33.01 18.2,33.08 18.02,33.08 17.95,33.01 17.95,32.71 17.87,32.63 17.7,32.63 17.62,32.71 17.62,33.01 17.54,33.08 17.37,33.08 17.29,33.01 17.29,32.71 17.21,32.63 15.25,32.63 15.1,32.79 v1(15.1,33.84)
DDR3_DQ5: length 21.2
  Top Layer w0.109: U7.C1 v1(19.7,42.09) ; U29.H8 v1(10.3,33.84)
  SIG03 w0.109: v1(19.7,42.09) 19.26,42.09 19.18,42.02 19.18,41.49 19.1,41.41 18.93,41.41 18.85,41.49 18.85,42.02 18.78,42.09 18.6,42.09 18.53,42.02 18.53,41.49 18.45,41.41 18.27,41.41 18.2,41.49 18.2,42.02 18.12,42.09 17.67,42.09 17.09,41.51 16.11,41.51 15.45,40.85 15.45,40.74 15.54,40.65 15.54,40.54 15.41,40.41 15.31,40.41 15.22,40.5 15.11,40.5 14.98,40.38 14.98,40.27 15.07,40.18 15.07,40.07 14.95,39.95 14.84,39.95 14.75,40.04 14.64,40.04 14.28,39.68 13.22,39.68 11.56,38.02 11.56,37.65 11.63,37.57 11.95,37.57 12.03,37.49 12.03,37.32 11.95,37.24 11.63,37.24 11.56,37.17 11.56,36.99 11.63,36.92 11.95,36.92 12.03,36.84 12.03,36.67 11.95,36.59 11.63,36.59 11.56,36.51 11.56,36.34 11.63,36.26 11.95,36.26 12.03,36.18 12.03,36.01 11.95,35.93 11.63,35.93 11.56,35.86 11.56,35.35 10.3,34.1 v1(10.3,33.84)
DDR3_DQ6: length 21.2
  Top Layer w0.109: U7.E1 v1(19.7,40.09) ; U29.G2 v1(15.9,33.04)
  SIG03 w0.109: v1(19.7,40.09) 19.7,39.75 19.8,39.66 20.23,39.66 20.3,39.59 20.3,38.79 20.37,38.71 20.55,38.71 20.62,38.79 20.62,39.57 20.71,39.66 20.88,39.66 20.95,39.59 20.95,38.77 21.03,38.69 21.2,38.69 21.29,38.78 21.29,39.58 21.36,39.66 21.73,39.66 21.87,39.52 21.87,38.84 22.27,38.43 22.27,37.95 21.76,37.44 21.6,37.44 21.43,37.27 21.43,36.72 21.58,36.57 21.58,36.4 21.5,36.32 21.32,36.32 21.25,36.24 21.25,35.98 20.71,35.44 20.6,35.44 20.48,35.56 20.37,35.56 20.24,35.44 20.24,35.33 20.37,35.21 20.37,35.1 20.29,35.02 19.57,35.02 19.17,34.62 19.17,34.03 18.58,33.44 18.29,33.44 18.22,33.52 18.22,33.97 18.14,34.05 17.97,34.05 17.89,33.97 17.89,33.52 17.81,33.44 17.64,33.44 17.56,33.52 17.56,33.97 17.48,34.05 17.31,34.05 17.23,33.97 17.23,33.52 17.16,33.44 16.3,33.44 v1(15.9,33.04)
DDR3_DQ7: length 21.2
  Top Layer w0.109: U29.H7 v1(11.1,33.84) ; v1(21.7,42.09) U7.B3
  SIG03 w0.109: v1(11.1,33.84) 11.1,34.29 12.39,35.58 12.39,37.94 13.6,39.15 15.43,39.15 15.86,39.58 15.97,39.58 16.21,39.34 16.32,39.34 16.44,39.46 16.44,39.57 16.2,39.81 16.2,39.92 16.33,40.04 16.43,40.04 16.68,39.8 16.79,39.8 16.91,39.92 16.91,40.03 16.67,40.27 16.67,40.38 16.96,40.67 17.4,40.67 17.47,40.59 17.47,40 17.55,39.92 17.72,39.92 17.8,40 17.8,40.59 17.88,40.67 18.05,40.67 18.13,40.59 18.13,40 18.21,39.92 18.38,39.92 18.46,40 18.46,40.59 18.53,40.67 18.99,40.67 20.43,42.11 21.68,42.11 v1(21.7,42.09)
DDR3_DQ8: length 17.7
  Top Layer w0.109: 22.2,32.59 21.77,33.03 20.08,33.03 19.29,32.23 v1(19.29,32.19) ; U29.D7 v1(11.1,30.64)
  Bottom Layer w0.109: v1(11.1,30.64) 11.59,30.15 11.87,30.15 11.95,30.23 11.95,31.02 11.87,31.09 11.35,31.09 11.27,31.17 11.27,31.34 11.35,31.42 11.87,31.42 11.95,31.5 11.95,31.75 12.03,31.83 12.2,31.83 12.28,31.75 12.28,30.23 12.36,30.15 17.41,30.15 19.29,32.03 v1(19.29,32.19)